# EAGLE design Dev-PCB (EAGLE 6.6.0)

## Sheet 1 of 2
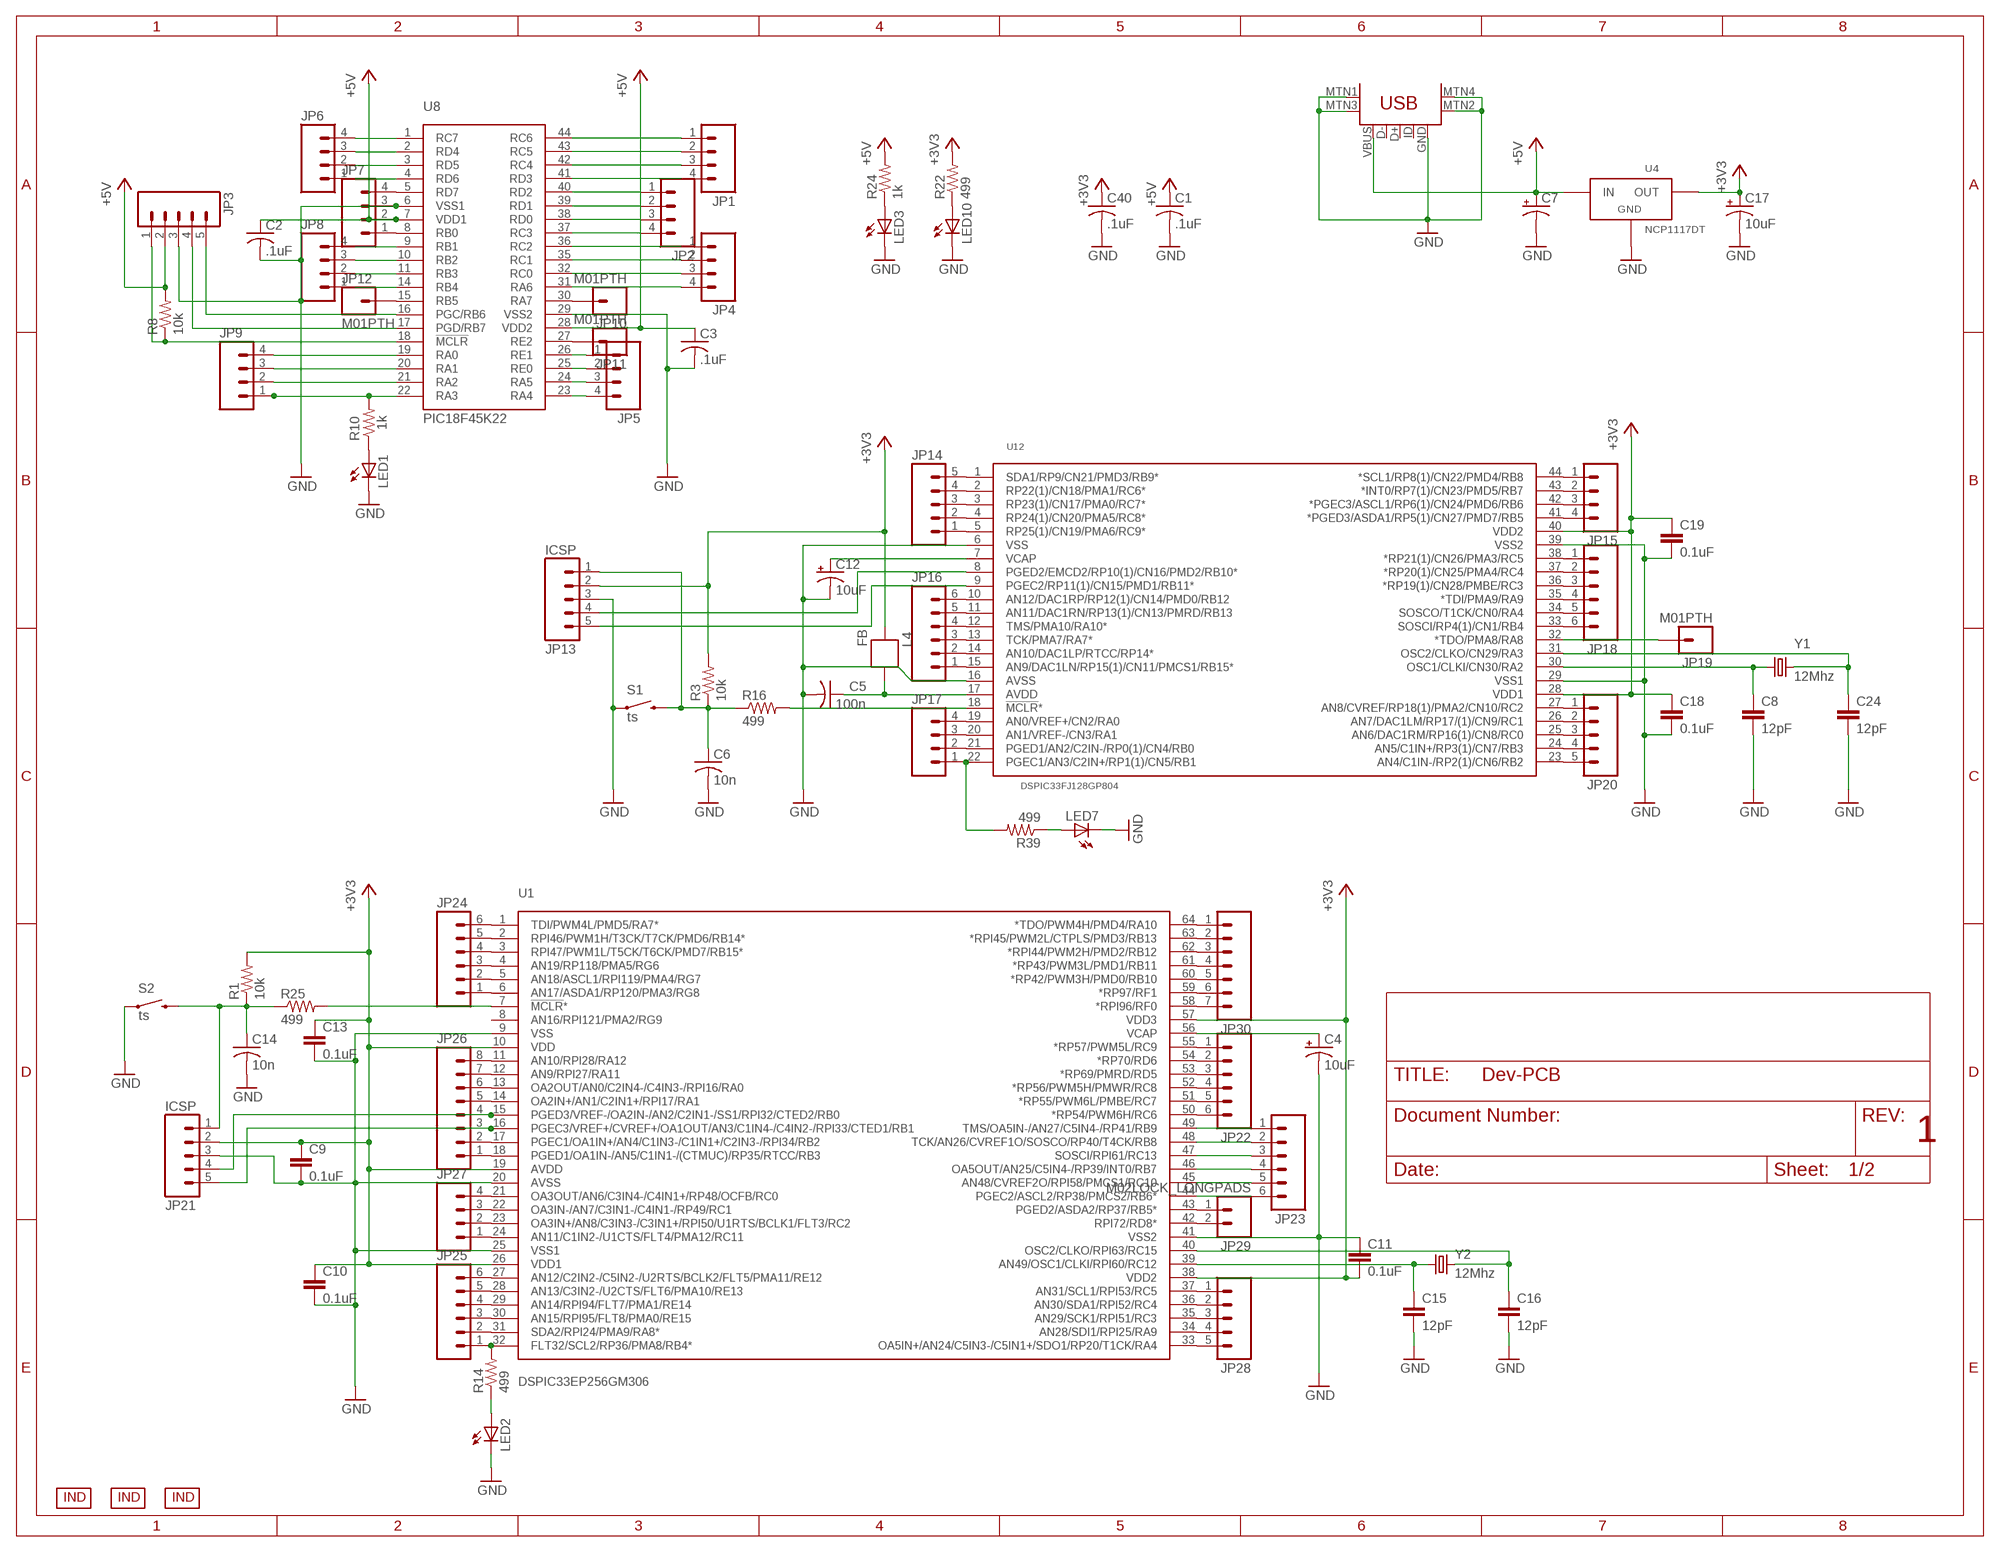
[diagram p0: schematic, sheet 1]

### Parts
C1  .1uF  C-USC0805  [C0805]
C2  .1uF  C-USC0805  [C0805]
C3  .1uF  C-USC0805  [C0805]
C4  10uF  10UF-TANT  [EIA3216]
C5  100n  C-USC0805  [C0805]
C6  10n  C-USC0805  [C0805]
C7  CAP_POL7343  [EIA7343]
C8  12pF  CAP0805  [0805]
C9  0.1uF  CAP0805  [0805]
C10  0.1uF  CAP0805  [0805]
C11  0.1uF  CAP0805  [0805]
C12  10uF  10UF-TANT  [EIA3216]
C13  0.1uF  CAP0805  [0805]
C14  10n  C-USC0805  [C0805]
C15  12pF  CAP0805  [0805]
C16  12pF  CAP0805  [0805]
C17  10uF  10UF-TANT  [EIA3216]
C18  0.1uF  CAP0805  [0805]
C19  0.1uF  CAP0805  [0805]
C24  12pF  CAP0805  [0805]
C40  .1uF  C-USC0805  [C0805]
JP1  M04LOCK_LONGPADS  [1X04_LOCK_LONGPADS]
JP2  M04LOCK_LONGPADS  [1X04_LOCK_LONGPADS]
JP3  M05LOCK_LONGPADS  [1X05_LOCK_LONGPADS]
JP4  M04LOCK_LONGPADS  [1X04_LOCK_LONGPADS]
JP5  M04LOCK_LONGPADS  [1X04_LOCK_LONGPADS]
JP6  M04LOCK_LONGPADS  [1X04_LOCK_LONGPADS]
JP7  M04LOCK_LONGPADS  [1X04_LOCK_LONGPADS]
JP8  M04LOCK_LONGPADS  [1X04_LOCK_LONGPADS]
JP9  M04LOCK_LONGPADS  [1X04_LOCK_LONGPADS]
JP10  M01PTH  [1X01]
JP11  M01PTH  [1X01]
JP12  M01PTH  [1X01]
JP13  ICSP  M05LOCK_LONGPADS  [1X05_LOCK_LONGPADS]
JP14  M05LOCK_LONGPADS  [1X05_LOCK_LONGPADS]
JP15  M04LOCK_LONGPADS  [1X04_LOCK_LONGPADS]
JP16  M06LOCK_LONGPADS  [1X06_LOCK_LONGPADS]
JP17  M04LOCK_LONGPADS  [1X04_LOCK_LONGPADS]
JP18  M06LOCK_LONGPADS  [1X06_LOCK_LONGPADS]
JP19  M01PTH  [1X01]
JP20  M05LOCK_LONGPADS  [1X05_LOCK_LONGPADS]
JP21  ICSP  M05LOCK_LONGPADS  [1X05_LOCK_LONGPADS]
JP22  M06LOCK_LONGPADS  [1X06_LOCK_LONGPADS]
JP23  M06LOCK_LONGPADS  [1X06_LOCK_LONGPADS]
JP24  M06LOCK_LONGPADS  [1X06_LOCK_LONGPADS]
JP25  M06LOCK_LONGPADS  [1X06_LOCK_LONGPADS]
JP26  M08LOCK_LONGPADS  [1X08_LOCK_LONGPADS]
JP27  M04LOCK_LONGPADS  [1X04_LOCK_LONGPADS]
JP28  M05LOCK_LONGPADS  [1X05_LOCK_LONGPADS]
JP29  M02LOCK_LONGPADS  [1X02_LOCK_LONGPADS]
JP30  M07LOCK_LONGPADS  [1X07_LOCK_LONGPADS]
L4  FB  [0603]
LED1  LEDCHIP-LED0805  [CHIP-LED0805]
LED2  LEDCHIP-LED0805  [CHIP-LED0805]
LED3  LEDCHIP-LED0805  [CHIP-LED0805]
LED7  LEDCHIP-LED0805  [CHIP-LED0805]
LED10  LEDCHIP-LED0805  [CHIP-LED0805]
R1  10k  RESISTOR0805-RES  [0805]
R3  10k  RESISTOR0805-RES  [0805]
R8  10k  RESISTOR0805-RES  [0805]
R10  1k  R-US_R0805  [R0805]
R14  499  RESISTOR0805-RES  [0805]
R16  499  RESISTOR0805-RES  [0805]
R22  499  R-US_R0805  [R0805]
R24  1k  R-US_R0805  [R0805]
R25  499  RESISTOR0805-RES  [0805]
R39  499  RESISTOR0805-RES  [0805]
S1  ts  SWITCH-MOMENTARY-2PTH  [TACTILE-PTH]
S2  ts  SWITCH-MOMENTARY-2PTH  [TACTILE-PTH]
U1  DSPIC33EP256GM306  [TQFP-64]
U4  NCP1117DT  [DPAK]
U8  PIC18F45K22  [TQFP-44]
U12  DSPIC33FJ128GP804  [TQFP-44]
U$1  USB-MINIB-5PIN  [USB-MINIB]
U$4  INDPK1  [PICKIT-PIN-1]
U$5  INDPK1  [PICKIT-PIN-1]
U$6  INDPK1  [PICKIT-PIN-1]
Y1  12Mhz  CRYSTAL5X3  [CRYSTAL-SMD-5X3]
Y2  12Mhz  CRYSTAL5X3  [CRYSTAL-SMD-5X3]

### Nets
+3V3: C9.1 C10.1 C11.2 C13.1 C17.A(+) C18.1 C19.1 C40.1 JP13.2 JP21.2 L4.2 R1.2 R3.2 R22.2 U1.10(VDD) U1.19(AVDD) U1.26(VDD1) U1.38(VDD2) U1.57(VDD3) U4.2(OUT) U12.28(VDD1) U12.40(VDD2)
+5V: C1.1 C2.1 C3.1 C7.A(+) JP3.2 JP7.2 R8.2 R24.2 U4.3(IN) U8.7(VDD1) U8.28(VDD2) U$1.VBUS
GND: C1.2 C2.2 C3.2 C4.C(-) C5.2 C6.2 C7.C(-) C8.2 C9.2 C10.2 C11.1 C12.C(-) C13.2 C14.2 C15.2 C16.2 C17.C(-) C18.2 C19.2 C24.2 C40.2 JP3.3 JP7.3 JP13.3 JP21.3 LED1.C LED2.C LED3.C LED7.C LED10.C S1.1 S2.1 U1.9(VSS) U1.20(AVSS) U1.25(VSS1) U1.41(VSS2) U4.1(GND) U8.6(VSS1) U8.29(VSS2) U12.6(VSS) U12.16(AVSS) U12.29(VSS1) U12.39(VSS2) U$1.GND U$1.MTN1(MTN2) U$1.MTN2(MTN3) U$1.MTN3(MTN1) U$1.MTN4
N$1: LED1.A R10.1
N$2: JP9.1 R10.2 U8.22(RA3)
N$3: JP1.1 U8.44(RC6)
N$4: JP1.2 U8.43(RC5)
N$5: JP1.3 U8.42(RC4)
N$6: JP1.4 U8.41(RD3)
N$7: JP2.1 U8.40(RD2)
N$8: JP2.2 U8.39(RD1)
N$9: JP2.3 U8.38(RD0)
N$10: JP2.4 U8.37(RC3)
N$11: JP4.1 U8.36(RC2)
N$12: JP4.2 U8.35(RC1)
N$13: JP4.3 U8.32(RC0)
N$14: JP4.4 U8.31(RA6)
N$15: LED2.A R14.1
N$16: JP5.1 U8.26(RE1)
N$17: JP5.2 U8.25(RE0)
N$18: JP5.3 U8.24(RA5)
N$19: LED10.A R22.1
N$20: JP5.4 U8.23(RA4)
N$21: JP6.1 U8.4(RD6)
N$22: JP6.2 U8.3(RD5)
N$23: JP6.3 U8.2(RD4)
N$24: JP6.4 U8.1(RC7)
N$25: LED3.A R24.1
N$26: JP7.1 U8.8(RB0)
N$27: JP7.4 U8.5(RD7)
N$28: JP8.1 U8.14(RB4)
N$29: JP8.2 U8.11(RB3)
N$30: JP8.3 U8.10(RB2)
N$31: JP8.4 U8.9(RB1)
N$32: JP9.2 U8.21(RA2)
N$33: JP9.3 U8.20(RA1)
N$34: JP9.4 U8.19(RA0)
N$35: JP10.1 U8.30(RA7)
N$36: JP11.1 U8.27(RE2)
N$37: JP12.1 U8.15(RB5)
N$38: LED7.A R39.1
N$39: C24.1 U12.31(OSC2/CLKO/CN29/RA3) Y1.3
N$40: JP3.4 U8.17(PGD/RB7)
N$41: C8.1 U12.30(OSC1/CLKI/CN30/RA2) Y1.1
N$42: C5.1 L4.1 U12.17(AVDD)
N$43: JP3.5 U8.16(PGC/RB6)
N$44: C12.A(+) U12.7(VCAP)
N$45: JP17.1 R39.2 U12.22(PGEC1/AN3/C2IN+/RP1(1)/CN5/RB1)
N$46: JP3.1 R8.1 U8.18(!MCLR)
N$47: C6.1 JP13.1 R3.1 R16.1 S1.3
N$48: R16.2 U12.18(!MCLR!*)
N$49: JP13.4 U12.8(PGED2/EMCD2/RP10(1)/CN16/PMD2/RB10*)
N$50: JP13.5 U12.9(PGEC2/RP11(1)/CN15/PMD1/RB11*)
N$51: JP14.1 U12.5(RP25(1)/CN19/PMA6/RC9*)
N$52: JP14.2 U12.4(RP24(1)/CN20/PMA5/RC8*)
N$53: JP14.3 U12.3(RP23(1)/CN17/PMA0/RC7*)
N$54: JP14.4 U12.2(RP22(1)/CN18/PMA1/RC6*)
N$55: JP14.5 U12.1(SDA1/RP9/CN21/PMD3/RB9*)
N$56: JP15.1 U12.44(*SCL1/RP8(1)/CN22/PMD4/RB8)
N$57: JP15.2 U12.43(*INT0/RP7(1)/CN23/PMD5/RB7)
N$58: JP15.3 U12.42(*PGEC3/ASCL1/RP6(1)/CN24/PMD6/RB6)
N$59: JP15.4 U12.41(*PGED3/ASDA1/RP5(1)/CN27/PMD7/RB5)
N$60: JP16.1 U12.15(AN9/DAC1LN/RP15(1)/CN11/PMCS1/RB15*)
N$61: JP16.2 U12.14(AN10/DAC1LP/RTCC/RP14*)
N$62: JP16.3 U12.13(TCK/PMA7/RA7*)
N$63: JP16.4 U12.12(TMS/PMA10/RA10*)
N$64: JP16.5 U12.11(AN11/DAC1RN/RP13(1)/CN13/PMRD/RB13)
N$65: JP16.6 U12.10(AN12/DAC1RP/RP12(1)/CN14/PMD0/RB12)
N$66: JP17.2 U12.21(PGED1/AN2/C2IN-/RP0(1)/CN4/RB0)
N$67: JP17.3 U12.20(AN1/VREF-/CN3/RA1)
N$68: JP17.4 U12.19(AN0/VREF+/CN2/RA0)
N$69: JP18.1 U12.38(*RP21(1)/CN26/PMA3/RC5)
N$70: JP18.2 U12.37(*RP20(1)/CN25/PMA4/RC4)
N$71: JP18.3 U12.36(*RP19(1)/CN28/PMBE/RC3)
N$72: JP18.4 U12.35(*TDI/PMA9/RA9)
N$73: JP18.5 U12.34(SOSCO/T1CK/CN0/RA4)
N$74: JP18.6 U12.33(SOSCI/RP4(1)/CN1/RB4)
N$75: JP19.1 U12.32(*TDO/PMA8/RA8)
N$76: JP20.1 U12.27(AN8/CVREF/RP18(1)/PMA2/CN10/RC2)
N$77: JP20.2 U12.26(AN7/DAC1LM/RP17/(1)/CN9/RC1)
N$78: JP20.3 U12.25(AN6/DAC1RM/RP16(1)/CN8/RC0)
N$79: JP20.4 U12.24(AN5/C1IN+/RP3(1)/CN7/RB3)
N$80: JP20.5 U12.23(AN4/C1IN-/RP2(1)/CN6/RB2)
N$81: JP25.1 R14.2 U1.32(FLT32/SCL2/RP36/PMA8/RB4*)
N$82: C16.1 U1.40(OSC2/CLKO/RPI63/RC15) Y2.3
N$83: C15.1 U1.39(AN49/OSC1/CLKI/RPI60/RC12) Y2.1
N$85: JP22.1 U1.55(*RP57/PWM5L/RC9)
N$86: C14.1 JP21.1 R1.1 R25.1 S2.3
N$87: R25.2 U1.7(!MCLR!*)
N$88: C4.A(+) U1.56(VCAP)
N$89: JP22.2 U1.54(*RP70/RD6)
N$90: JP21.4 JP26.4 U1.15(PGED3/VREF-/OA2IN-/AN2/C2IN1-/SS1/RPI32/CTED2/RB0)
N$91: JP21.5 JP26.3 U1.16(PGEC3/VREF+/CVREF+/OA1OUT/AN3/C1IN4-/C4IN2-/RPI33/CTED1/RB1)
N$92: JP22.3 U1.53(*RP69/PMRD/RD5)
N$93: JP22.4 U1.52(*RP56/PWM5H/PMWR/RC8)
N$94: JP22.5 U1.51(*RP55/PWM6L/PMBE/RC7)
N$95: JP22.6 U1.50(*RP54/PWM6H/RC6)
N$96: JP23.1 U1.49(TMS/OA5IN-/AN27/C5IN4-/RP41/RB9)
N$97: JP23.2 U1.48(TCK/AN26/CVREF1O/SOSCO/RP40/T4CK/RB8)
N$98: JP23.3 U1.47(SOSCI/RPI61/RC13)
N$99: JP23.4 U1.46(OA5OUT/AN25/C5IN4-/RP39/INT0/RB7)
N$100: JP23.5 U1.45(AN48/CVREF2O/RPI58/PMCS1/RC10)
N$101: JP23.6 U1.44(PGEC2/ASCL2/RP38/PMCS2/RB6*)
N$102: JP24.1 U1.6(AN17/ASDA1/RP120/PMA3/RG8)
N$103: JP24.2 U1.5(AN18/ASCL1/RPI119/PMA4/RG7)
N$104: JP24.3 U1.4(AN19/RP118/PMA5/RG6)
N$105: JP24.4 U1.3(RPI47/PWM1L/T5CK/T6CK/PMD7/RB15*)
N$106: JP24.5 U1.2(RPI46/PWM1H/T3CK/T7CK/PMD6/RB14*)
N$107: JP24.6 U1.1(TDI/PWM4L/PMD5/RA7*)
N$108: JP25.2 U1.31(SDA2/RPI24/PMA9/RA8*)
N$109: JP25.3 U1.30(AN15/RPI95/FLT8/PMA0/RE15)
N$110: JP25.4 U1.29(AN14/RPI94/FLT7/PMA1/RE14)
N$111: JP25.5 U1.28(AN13/C3IN2-/U2CTS/FLT6/PMA10/RE13)
N$112: JP25.6 U1.27(AN12/C2IN2-/C5IN2-/U2RTS/BCLK2/FLT5/PMA11/RE12)
N$113: JP26.1 U1.18(PGED1/OA1IN-/AN5/C1IN1-/(CTMUC)/RP35/RTCC/RB3)
N$114: JP26.2 U1.17(PGEC1/OA1IN+/AN4/C1IN3-/C1IN1+/C2IN3-/RPI34/RB2)
N$115: JP26.5 U1.14(OA2IN+/AN1/C2IN1+/RPI17/RA1)
N$116: JP26.6 U1.13(OA2OUT/AN0/C2IN4-/C4IN3-/RPI16/RA0)
N$117: JP26.7 U1.12(AN9/RPI27/RA11)
N$118: JP26.8 U1.11(AN10/RPI28/RA12)
N$119: JP27.1 U1.24(AN11/C1IN2-/U1CTS/FLT4/PMA12/RC11)
N$120: JP27.2 U1.23(OA3IN+/AN8/C3IN3-/C3IN1+/RPI50/U1RTS/BCLK1/FLT3/RC2)
N$121: JP27.3 U1.22(OA3IN-/AN7/C3IN1-/C4IN1-/RP49/RC1)
N$122: JP27.4 U1.21(OA3OUT/AN6/C3IN4-/C4IN1+/RP48/OCFB/RC0)
N$123: JP28.1 U1.37(AN31/SCL1/RPI53/RC5)
N$124: JP28.2 U1.36(AN30/SDA1/RPI52/RC4)
N$125: JP28.3 U1.35(AN29/SCK1/RPI51/RC3)
N$126: JP28.4 U1.34(AN28/SDI1/RPI25/RA9)
N$127: JP28.5 U1.33(OA5IN+/AN24/C5IN3-/C5IN1+/SDO1/RP20/T1CK/RA4)
N$128: JP29.1 U1.43(PGED2/ASDA2/RP37/RB5*)
N$129: JP29.2 U1.42(RPI72/RD8*)
N$130: JP30.1 U1.64(*TDO/PWM4H/PMD4/RA10)
N$131: JP30.2 U1.63(*RPI45/PWM2L/CTPLS/PMD3/RB13)
N$132: JP30.3 U1.62(*RPI44/PWM2H/PMD2/RB12)
N$133: JP30.4 U1.61(*RP43/PWM3L/PMD1/RB11)
N$134: JP30.5 U1.60(*RP42/PWM3H/PMD0/RB10)
N$135: JP30.6 U1.59(*RP97/RF1)
N$136: JP30.7 U1.58(*RPI96/RF0)
Unconnected: U1.8(AN16/RPI121/PMA2/RG9) U$1.D+ U$1.D- U$1.ID

### Notes on the sheet
- 1

## Sheet 2 of 2
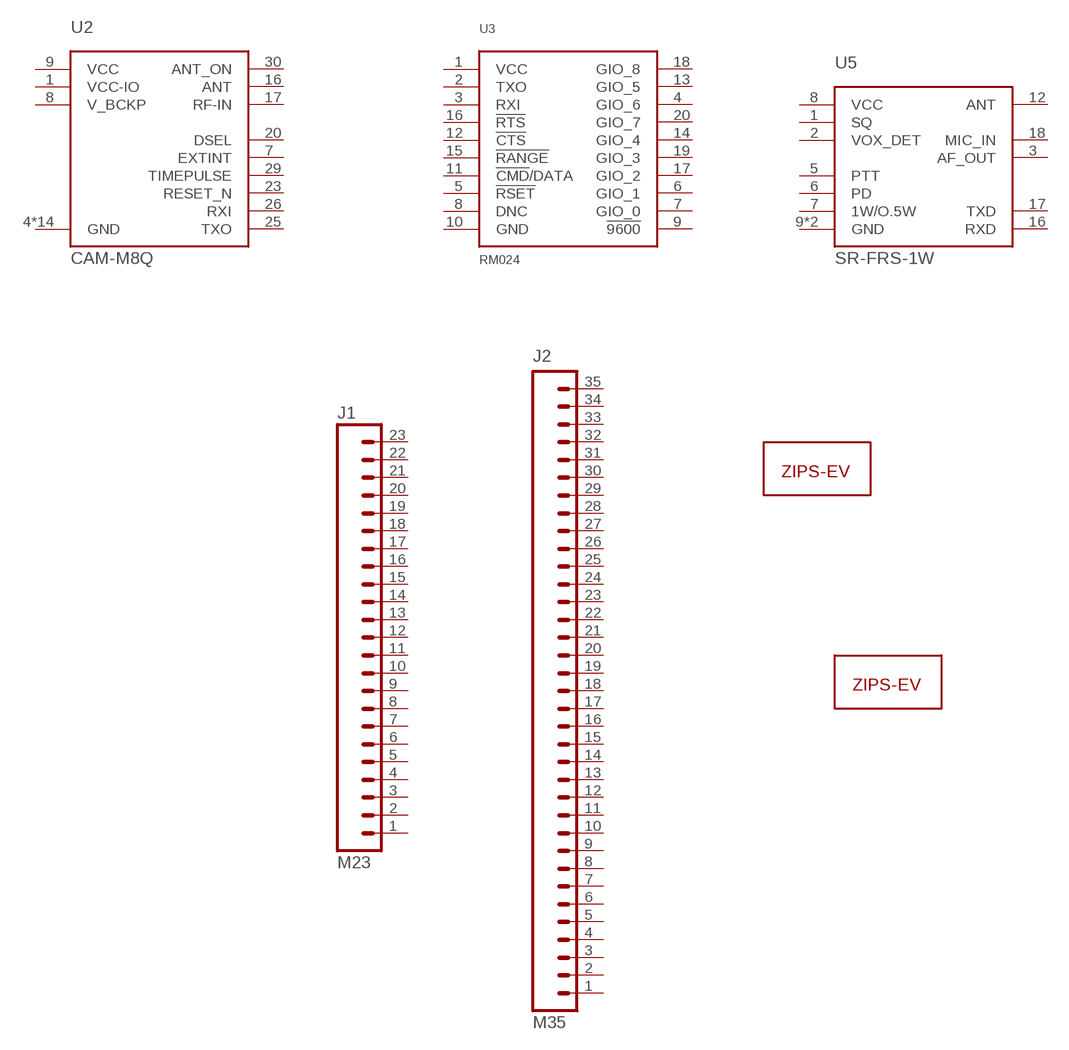
[diagram p1: schematic, sheet 2]

### Parts
J1  M23  [1-770669-1]
J2  M35  [1-776163-2]
U2  CAM-M8Q  [CAM-M8Q]
U3  RM024  [RM024-TH]
U5  SR-FRS-1W  [SR-FRS-1W]
U$2  LOGO  [L-S]
U$3  LOGOL  [L-L]
Unconnected: J1.1 J1.2 J1.3 J1.4 J1.5 J1.6 J1.7 J1.8 J1.9 J1.10 J1.11 J1.12 J1.13 J1.14 J1.15 J1.16 J1.17 J1.18 J1.19 J1.20 J1.21 J1.22 J1.23 J2.1 J2.2 J2.3 J2.4 J2.5 J2.6 J2.7 J2.8 J2.9 J2.10 J2.11 J2.12 J2.13 J2.14 J2.15 J2.16 J2.17 J2.18 J2.19 J2.20 J2.21 J2.22 J2.23 J2.24 J2.25 J2.26 J2.27 J2.28 J2.29 J2.30 J2.31 J2.32 J2.33 J2.34 J2.35 U2.1(VCC-IO) U2.4(GND) U2.5(GND) U2.7(EXTINT) U2.8(V_BCKP) U2.9(VCC) U2.10(GND) U2.11(GND) U2.12(GND) U2.13(GND) U2.14(GND) U2.15(GND) U2.16(ANT) U2.17(RF-IN) U2.18(GND) U2.19(GND) U2.20(DSEL) U2.21(GND) U2.22(GND) U2.23(RESET_N) U2.25(TXO) U2.26(RXI) U2.27(GND) U2.29(TIMEPULSE) U2.30(ANT_ON) U2.31(GND) U3.1(VCC) U3.2(TXO) U3.3(RXI) U3.4(GIO_6) U3.5(!RSET) U3.6(GIO_1) U3.7(GIO_0) U3.8(DNC) U3.9(!9600) U3.10(GND) U3.11(!CMD!/DATA) U3.12(!CTS) U3.13(GIO_5) U3.14(GIO_4) U3.15(!RANGE) U3.16(!RTS) U3.17(GIO_2) U3.18(GIO_8) U3.19(GIO_3) U3.20(GIO_7) U5.1(SQ) U5.2(VOX_DET) U5.3(AF_OUT) U5.5(PTT) U5.6(PD) U5.7(1W/O.5W) U5.8(VCC) U5.9(GND) U5.10(GND) U5.12(ANT) U5.16(RXD) U5.17(TXD) U5.18(MIC_IN)

## Library data of the parts
C1-C3 C5 C6 C14 C40 = adafruit:C-US: CAPACITOR, American symbol
C4 C12 C17 = SparkFun-Capacitors:10UF-TANT: 10uF Tantalum SMT CAP-00811- 16V 10% (EIA-3216); PROD_ID: CAP-00811
C7 = SparkFun-Capacitors:CAP_POL: Capacitor Polarized These are standard SMD and PTH capacitors. Normally 10uF, 47uF, and 100uF in electrolytic and tantalum varieties. Always verify the external diameter of the through hole cap, it varies with capacity, voltage, and manufacturer. The EIA devices should be standard.
C8-C11 C13 C15 C16 C18 C19 C24 = SparkFun-Capacitors:CAP: Capacitor Standard 0603 ceramic capacitor, and 0.1" leaded capacitor.
J1 = FSAE Eletric:M23
J2 = FSAE Eletric:M35
JP1 JP2 JP4-JP9 JP15 JP17 JP27 = SparkFun-Connectors:M04: Header 4 Standard 4-pin 0.1" header. Use with straight break away headers (SKU : PRT-00116), right angle break away headers (PRT-00553), swiss pins (PRT-00743), machine pins (PRT-00117), and female headers (PRT-00115). Molex polarized connector foot print use with SKU : PRT-08231 with associated crimp pins and housings. 1MM SMD Version SKU: PRT-10208
JP3 JP13 JP14 JP20 JP21 JP28 = SparkFun-Connectors:M05: Header 5 Standard 5-pin 0.1" header. Use with straight break away headers (SKU : PRT-00116), right angle break away headers (PRT-00553), swiss pins (PRT-00743), machine pins (PRT-00117), and female headers (PRT-00115). Molex polarized connector foot print use with SKU : PRT-08230 with associated crimp pins and housings.
JP10-JP12 JP19 = SparkFun-Connectors:M01: Header 1 Standard 1-pin 0.1" header. Use with straight break away headers (SKU : PRT-00116), right angle break away headers (PRT-00553), swiss pins (PRT-00743), machine pins (PRT-00117), and female headers (PRT-00115).
JP16 JP18 JP22-JP25 = SparkFun-Connectors:M06: Header 6 Standard 6-pin 0.1" header. Use with straight break away headers (SKU : PRT-00116), right angle break away headers (PRT-00553), swiss pins (PRT-00743), machine pins (PRT-00117), and female headers (PRT-00115). Molex polarized connector foot print use with SKU : PRT-08094 with associated crimp pins and housings. NOTES ON THE VARIANTS LOCK and LOCK_LONGPADS... This footprint was designed to help hold the alignment of a through-hole component (i.e. 6-pin header) while soldering it into place. You may notice that each hole has been shifted either up or down by 0.005 of an inch from it's more standard position (which is a perfectly straight line). This slight alteration caused the pins (the squares in the middle) to touch the edges of the holes. Because they are alternating, it causes a "brace" to hold the component in place. 0.005 has proven to be the perfect amount of "off-center" position when using our standard breakaway headers. Although looks a little odd when you look at the bare footprint, once you have a header in there, the alteration is very hard to notice. Also,if you push a header all the way into place, it is covered up entirely on the bottom side. This idea of altering the position of holes to aid alignment will be further integrated into the Sparkfun Library for other footprints. It can help hold any component with 3 or more connection pins.
JP26 = SparkFun-Connectors:M08: Header 8 Standard 8-pin 0.1" header. Use with straight break away headers (SKU : PRT-00116), right angle break away headers (PRT-00553), swiss pins (PRT-00743), machine pins (PRT-00117), and female headers (PRT-00115).
JP29 = SparkFun-Connectors:M02: Standard 2-pin 0.1" header. Use with - straight break away headers ( PRT-00116) - right angle break away headers (PRT-00553) - swiss pins (PRT-00743) - machine pins (PRT-00117) - female headers (PRT-00115) Molex polarized connector foot print use with: PRT-08233 with associated crimp pins and housings. 2.54_SCREWTERM for use with PRT-10571. 3.5mm Screw Terminal footprints for PRT-08084 5mm Screw Terminal footprints for use with PRT-08433
JP30 = SparkFun-Connectors:M07: Header 7 Standard 7-pin 0.1" header. Use with straight break away headers (SKU : PRT-00116), right angle break away headers (PRT-00553), swiss pins (PRT-00743), machine pins (PRT-00117), and female headers (PRT-00115). NOTES ON THE VARIANTS LOCK and LOCK_LONGPADS... This footprint was designed to help hold the alignment of a through-hole component (i.e. 7-pin header) while soldering it into place. You may notice that each hole has been shifted either up or down by 0.005 of an inch from it's more standard position (which is usually a perfectly straight line). This slight alteration caused the pins (the squares in the middle) to touch the edges of the holes. Because they are alternating, it causes a "brace" to hold the header in place. 0.005 has proven to be the perfect amount of "off-center" position when using our standard breakaway headers. Although looks a little odd when you look at the bare footprint, once you have a header in there, the alteration is very hard to notice. Also, if you push a header all the way into place, it is covered up entirely on the bottom side. This idea of altering the position of holes to aid alignment will be further integrated into the Sparkfun Library for other footprints. It can help hold any component with 3 or more connection pins.
L4 = SparkFun-Passives:FB
LED1-LED3 LED7 LED10 = adafruit:LED: LED OSRAM: - CHIPLED LG R971, LG N971, LY N971, LG Q971, LY Q971, LO R971, LY R971 LH N974, LH R974 LS Q976, LO Q976, LY Q976 LO Q996 - Hyper CHIPLED LW Q18S LB Q993, LB Q99A, LB R99A - SideLED LS A670, LO A670, LY A670, LG A670, LP A670 LB A673, LV A673, LT A673, LW A673 LH A674 LY A675 LS A676, LA A676, LO A676, LY A676, LW A676 LS A679, LY A679, LG A679 - Hyper Micro SIDELED® LS Y876, LA Y876, LO Y876, LY Y876 LT Y87S - SmartLED LW L88C, LW L88S LB L89C, LB L89S, LG L890 LS L89K, LO L89K, LY L89K LS L896, LA L896, LO L896, LY L896 - TOPLED LS T670, LO T670, LY T670, LG T670, LP T670 LSG T670, LSP T670, LSY T670, LOP T670, LYG T670 LG T671, LOG T671, LSG T671 LB T673, LV T673, LT T673, LW T673 LH T674 LS T676, LA T676, LO T676, LY T676, LB T676, LH T676, LSB T676, LW T676 LB T67C, LV T67C, LT T67C, LS T67K, LO T67K, LY T67K, LW E67C LS E67B, LA E67B, LO E67B, LY E67B, LB E67C, LV E67C, LT E67C LW T67C LS T679, LY T679, LG T679 LS T770, LO T770, LY T770, LG T770, LP T770 LB T773, LV T773, LT T773, LW T773 LH T774 LS E675, LA E675, LY E675, LS T675 LS T776, LA T776, LO T776, LY T776, LB T776 LHGB T686 LT T68C, LB T68C - Hyper Mini TOPLED® LB M676 - Mini TOPLED Santana® LG M470 LS M47K, LO M47K, LY M47K Source: http://www.osram.convergy.de/
R1 R3 R8 R14 R39 = SparkFun-Passives:RESISTOR: Resistor Basic schematic elements and footprints for 0603, 1206, and PTH resistors.
R10 R22 R24 = adafruit:R-US_: RESISTOR, American symbol
R16 R25 = SparkFun-Resistors:RESISTOR: Resistor Basic schematic elements and footprints for 0603, 1206, and PTH resistors.
S1 S2 = SparkFun-Electromechanical:SWITCH-MOMENTARY-2: Various NO switches- pushbuttons, reed, etc
U1 = FSAE Eletric:DSPIC33EP256GM306
U2 = FSAE Eletric:CAM-M8Q
U3 = FSAE Eletric:RM024
U4 = FSAE Eletric:NCP1117DT
U5 = FSAE Eletric:SR-FRS-1W
U8 = FSAE Eletric:PIC18F45K22
U12 = FSAE Eletric:DSPIC33FJ128GP804
U$1 = SparkFun-Connectors:USB-MINIB: Mini-USB "B" connector with 5th pin broken out. Created new symbol breaking out 5th "ID" pin in mini/micro USB connector spec. See: http://en.wikipedia.org/wiki/Mini_usb#Cables. Uses same footprint as 4-pin symbol. Also added pins to connect to mounting / shield pads if required (probably not generally needed as signals aren't shielded once they leave the connector).
U$2 U$3 = untitled:LOGO
U$4-U$6 = FSAE Eletric:IND
Y1 Y2 = SparkFun-FreqCtrl:CRYSTAL: Various standard crystals. Proven footprints. Spark Fun Electronics SKU : COM-00534

## Board
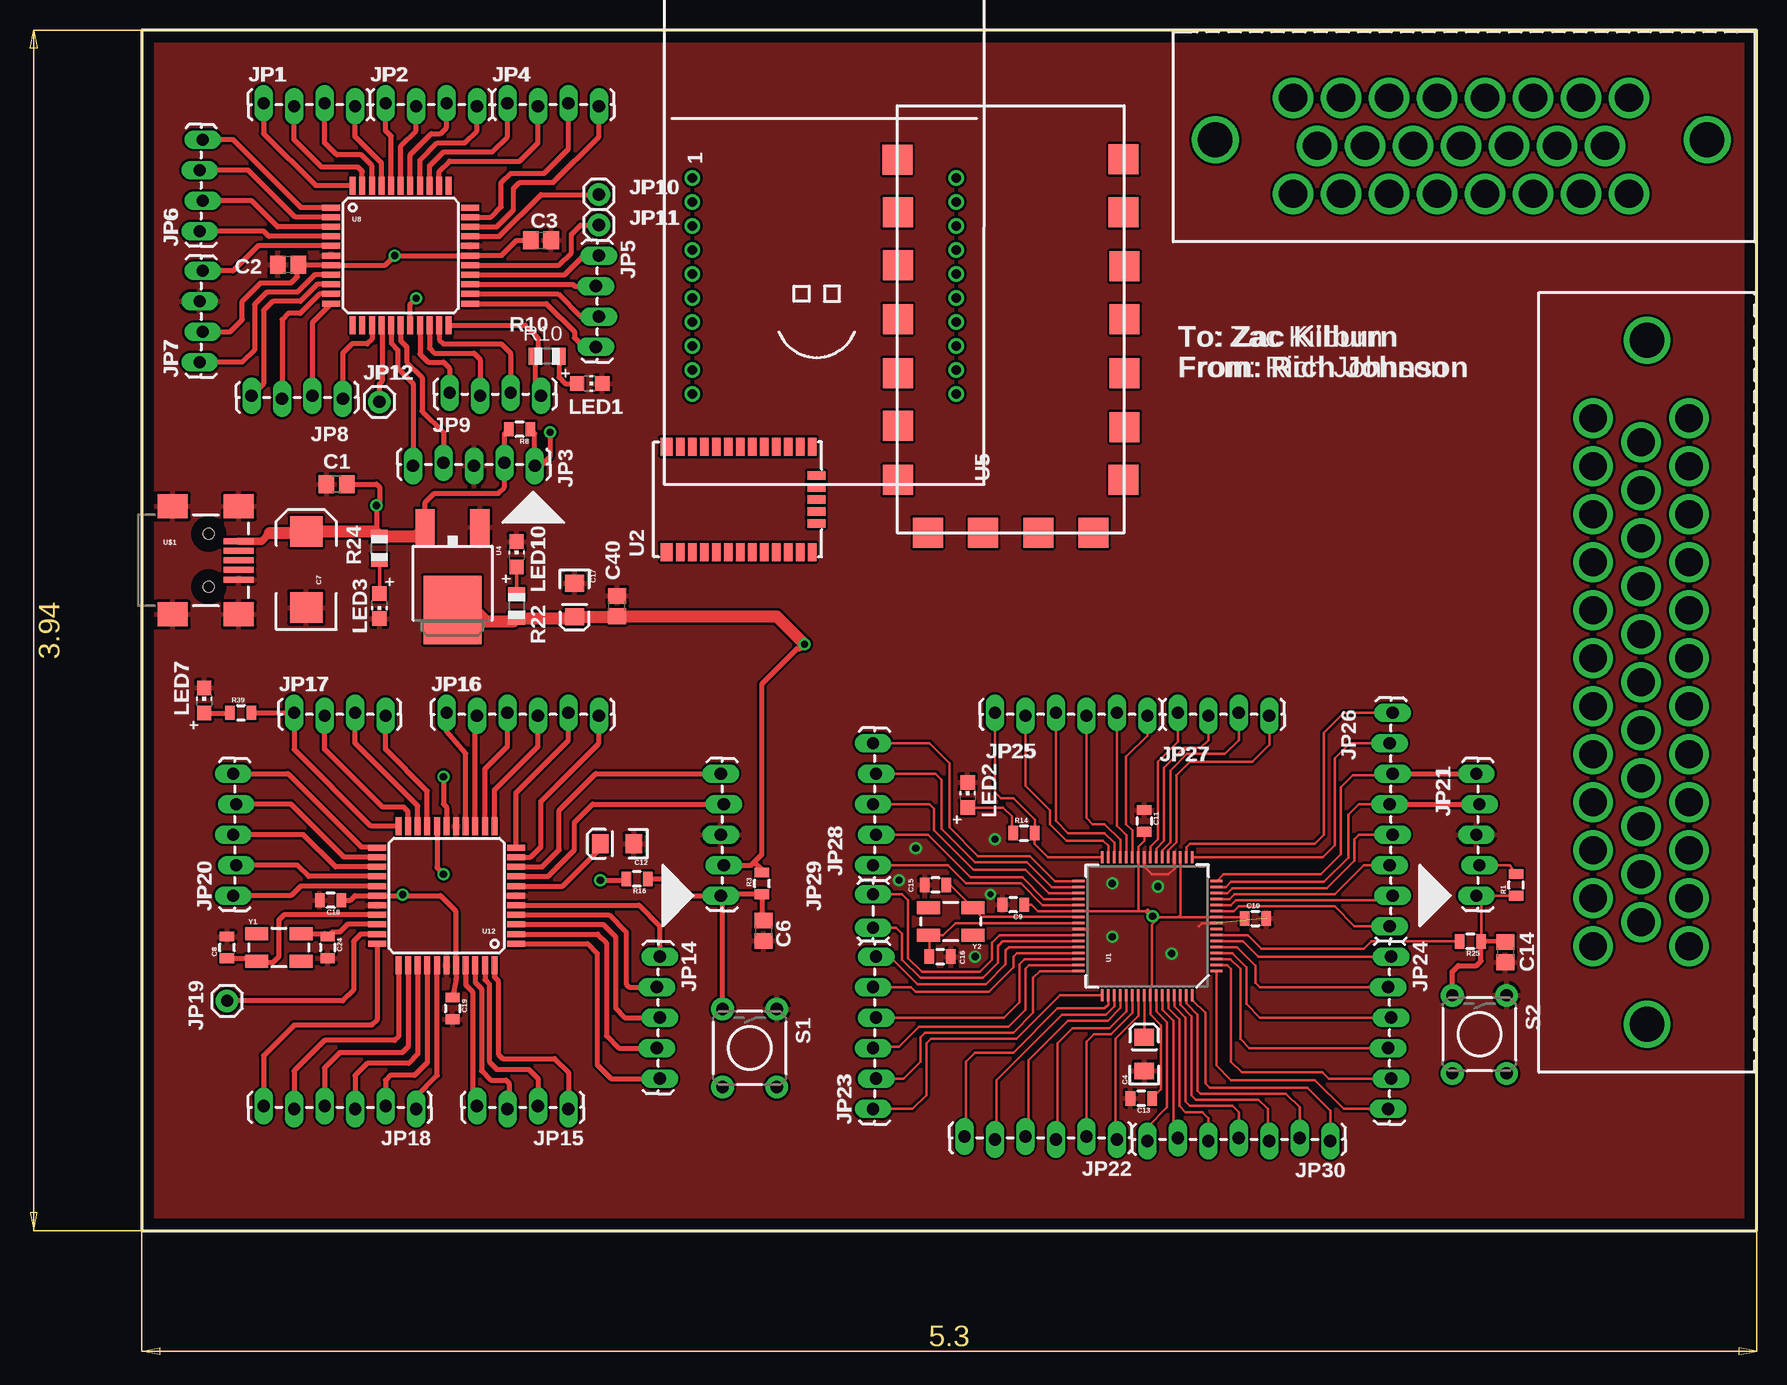
[diagram p2: board, top side]